# Altium schematic sheet 控制板.SchDoc (part 1 of 2)
size 1397 x 1143 mm; SheetNumber: 0; SheetTotal: 0
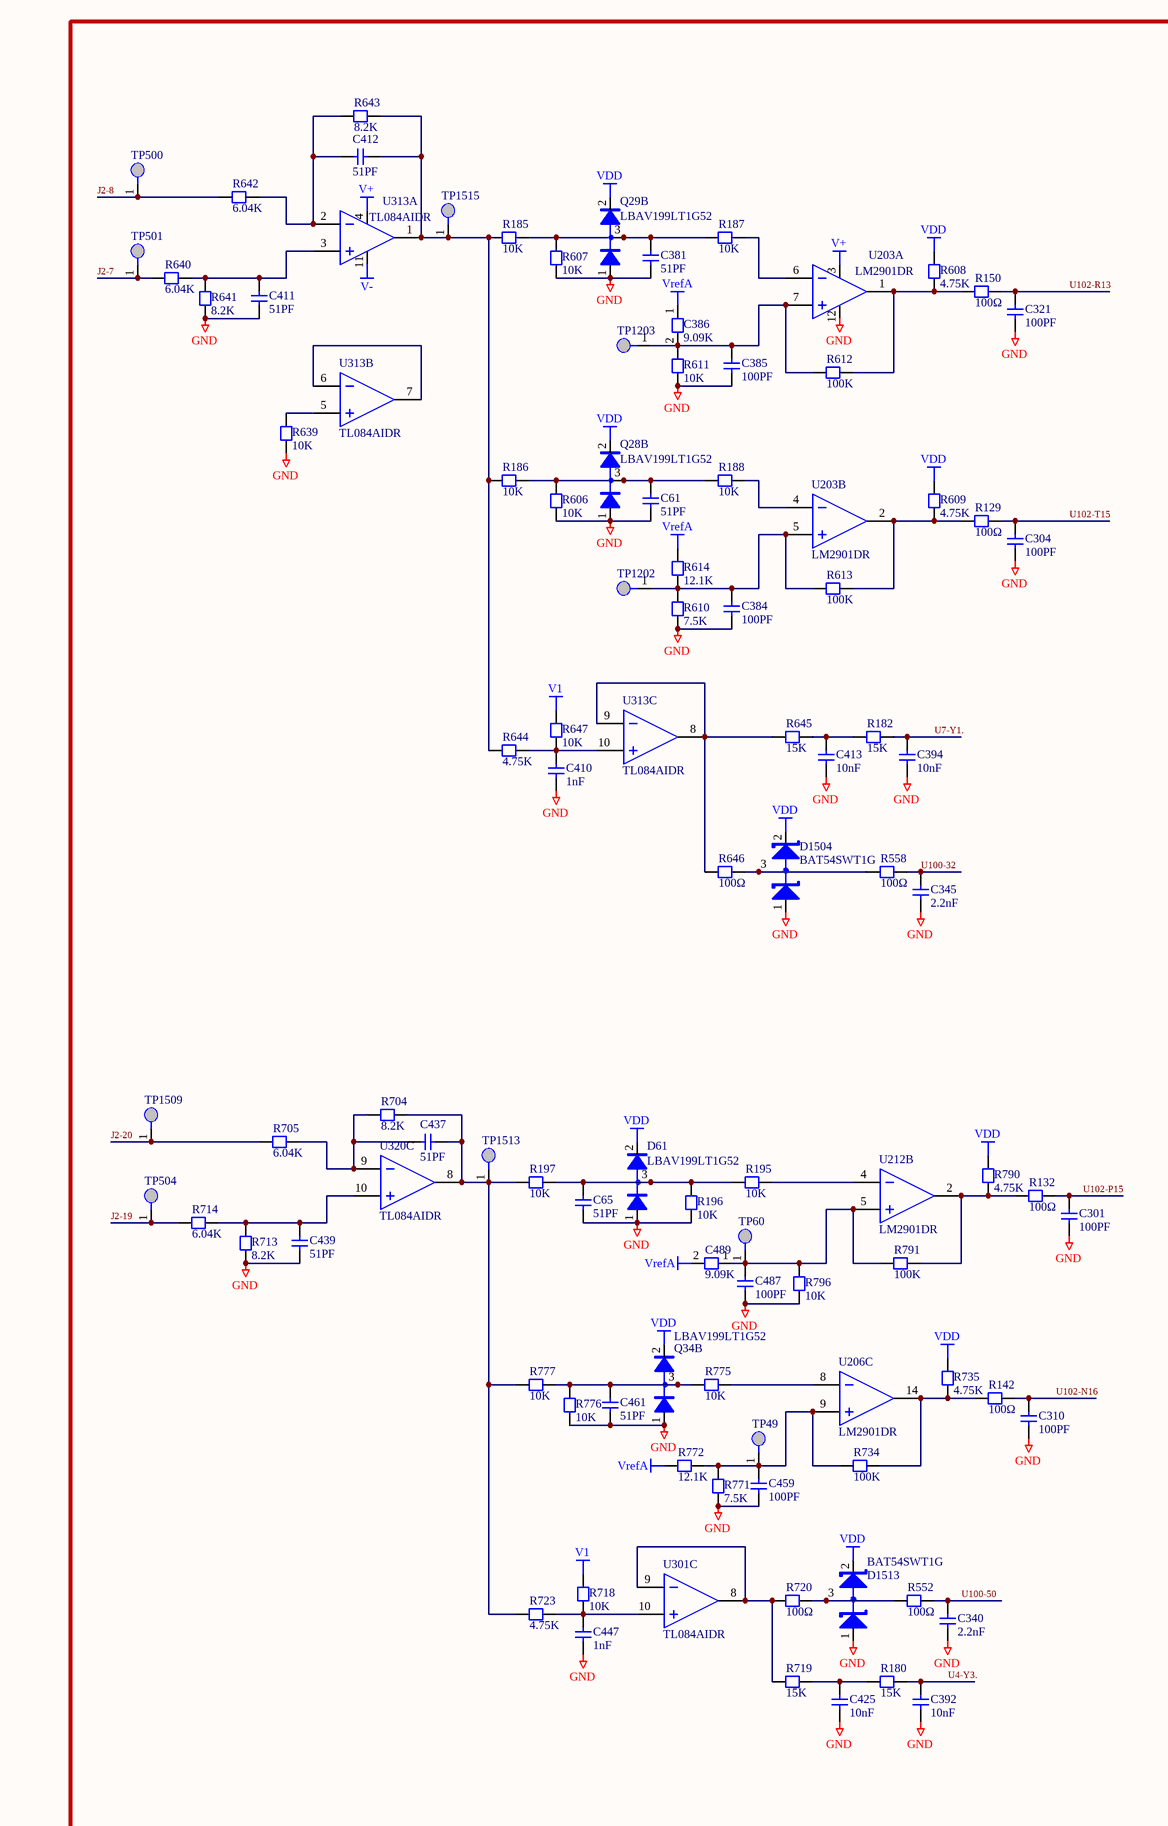
[diagram p0: 控制板.SchDoc, top column 1 of 4]
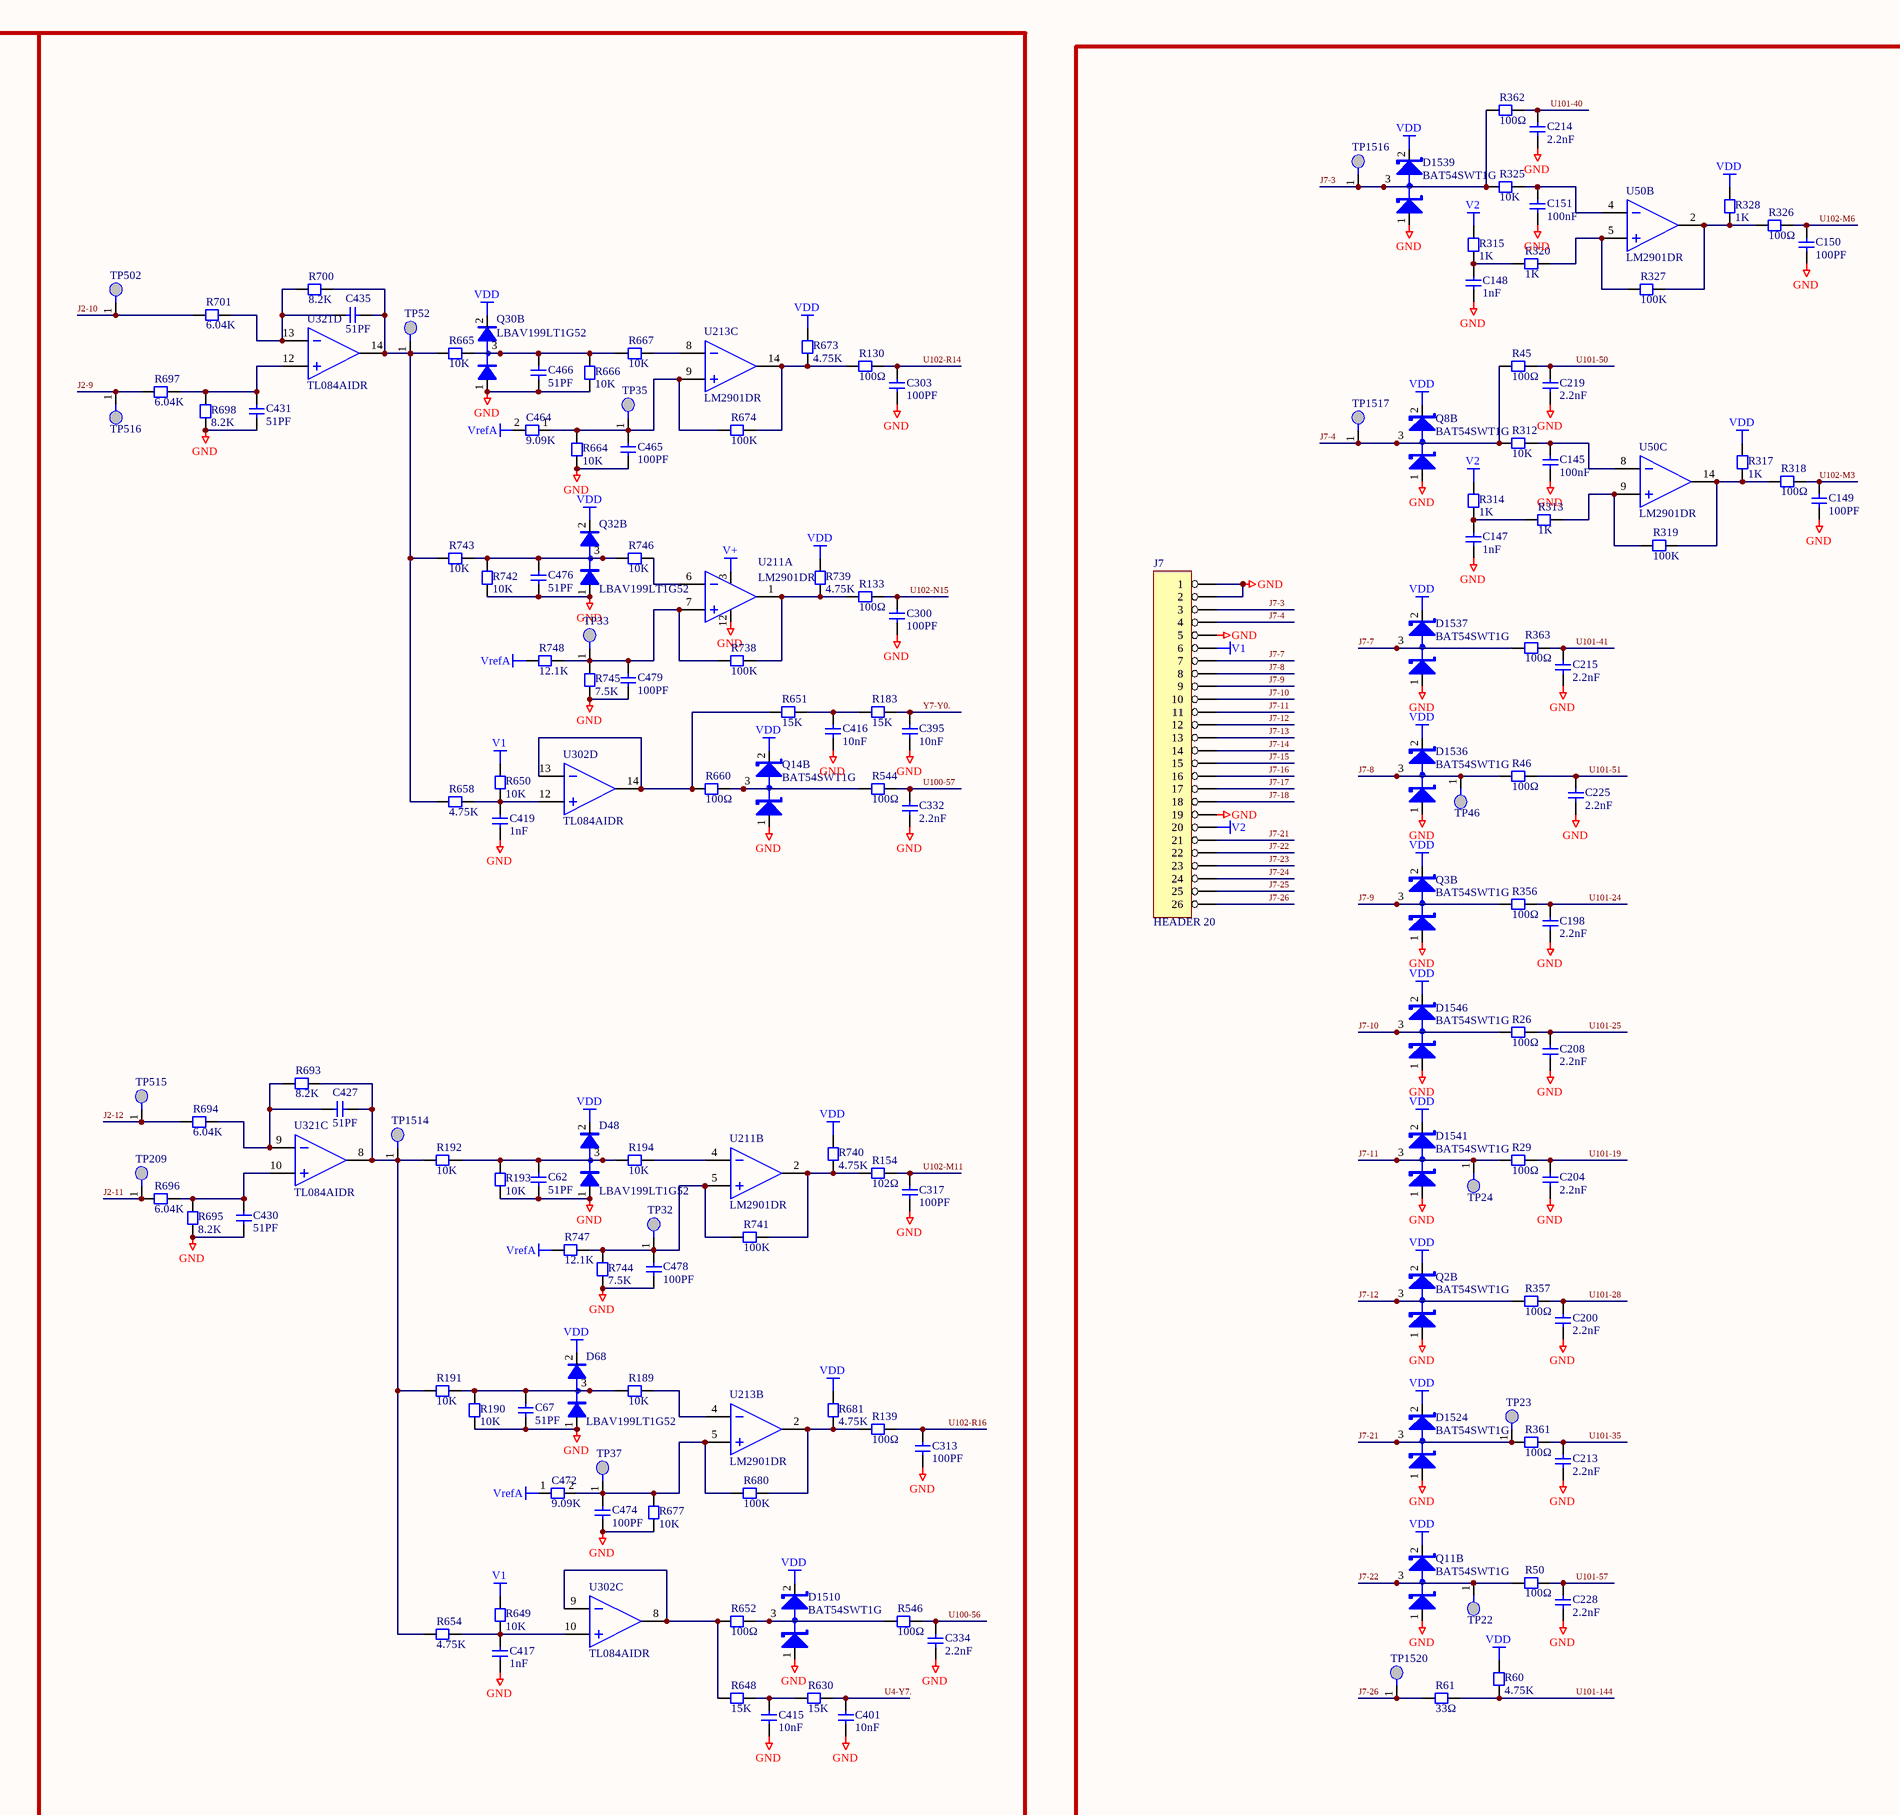
[diagram p1: 控制板.SchDoc, top column 2 of 4]
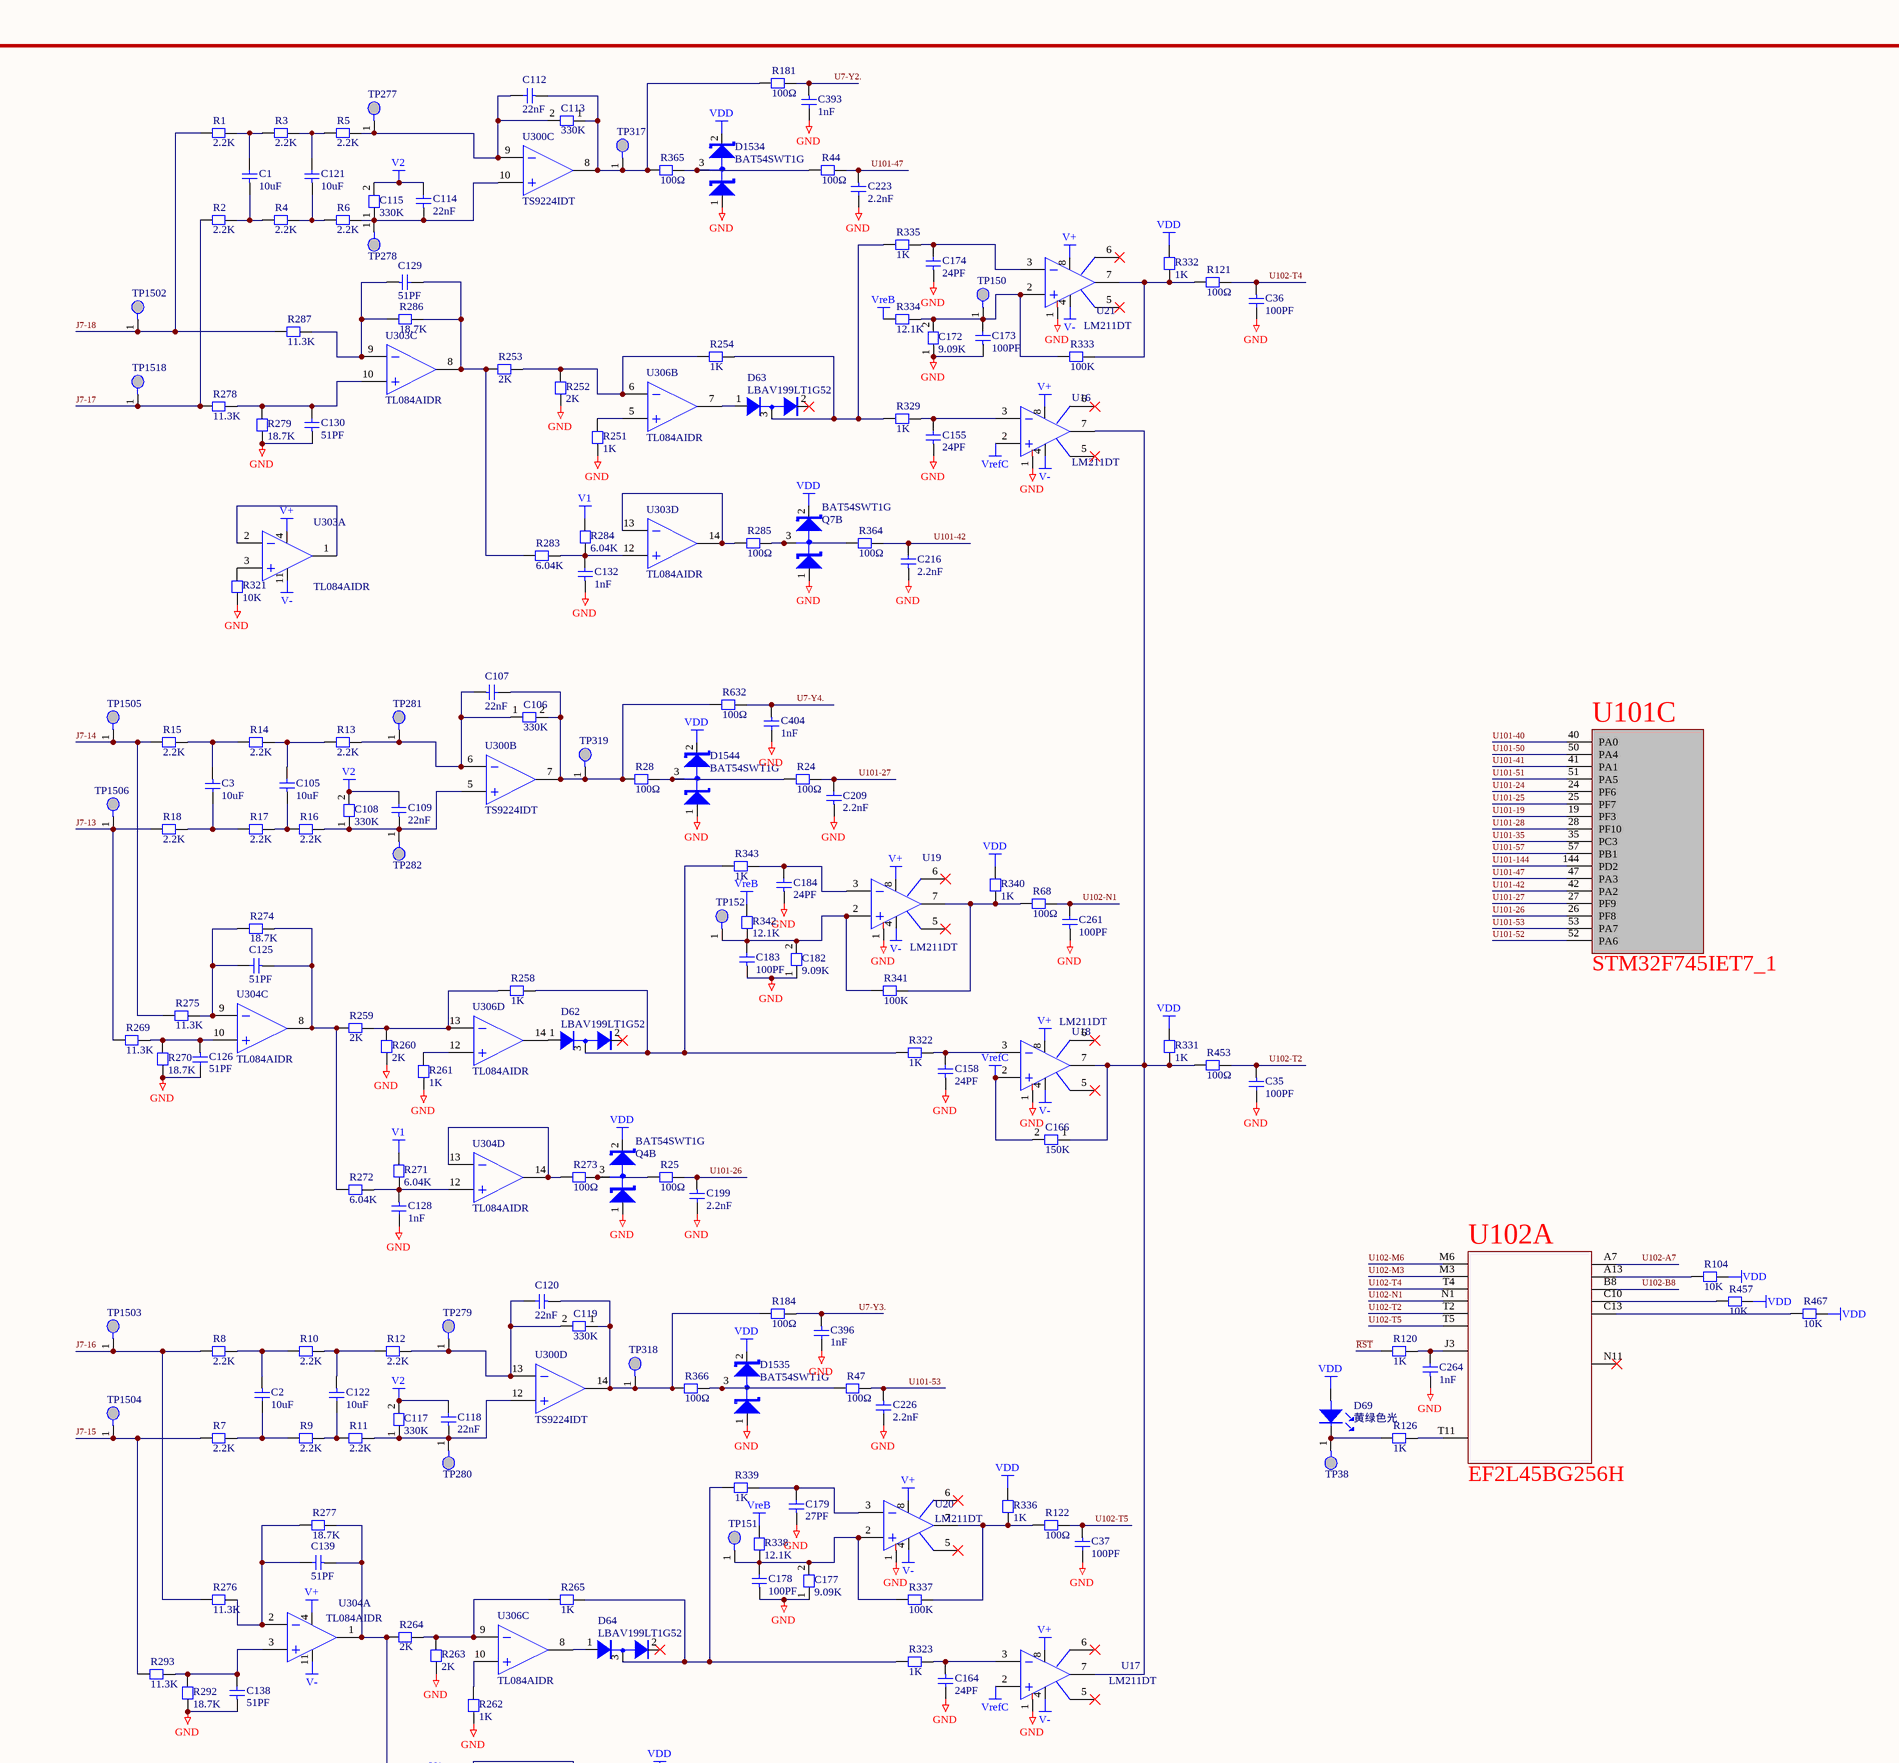
[diagram p2: 控制板.SchDoc, top column 3 of 4]
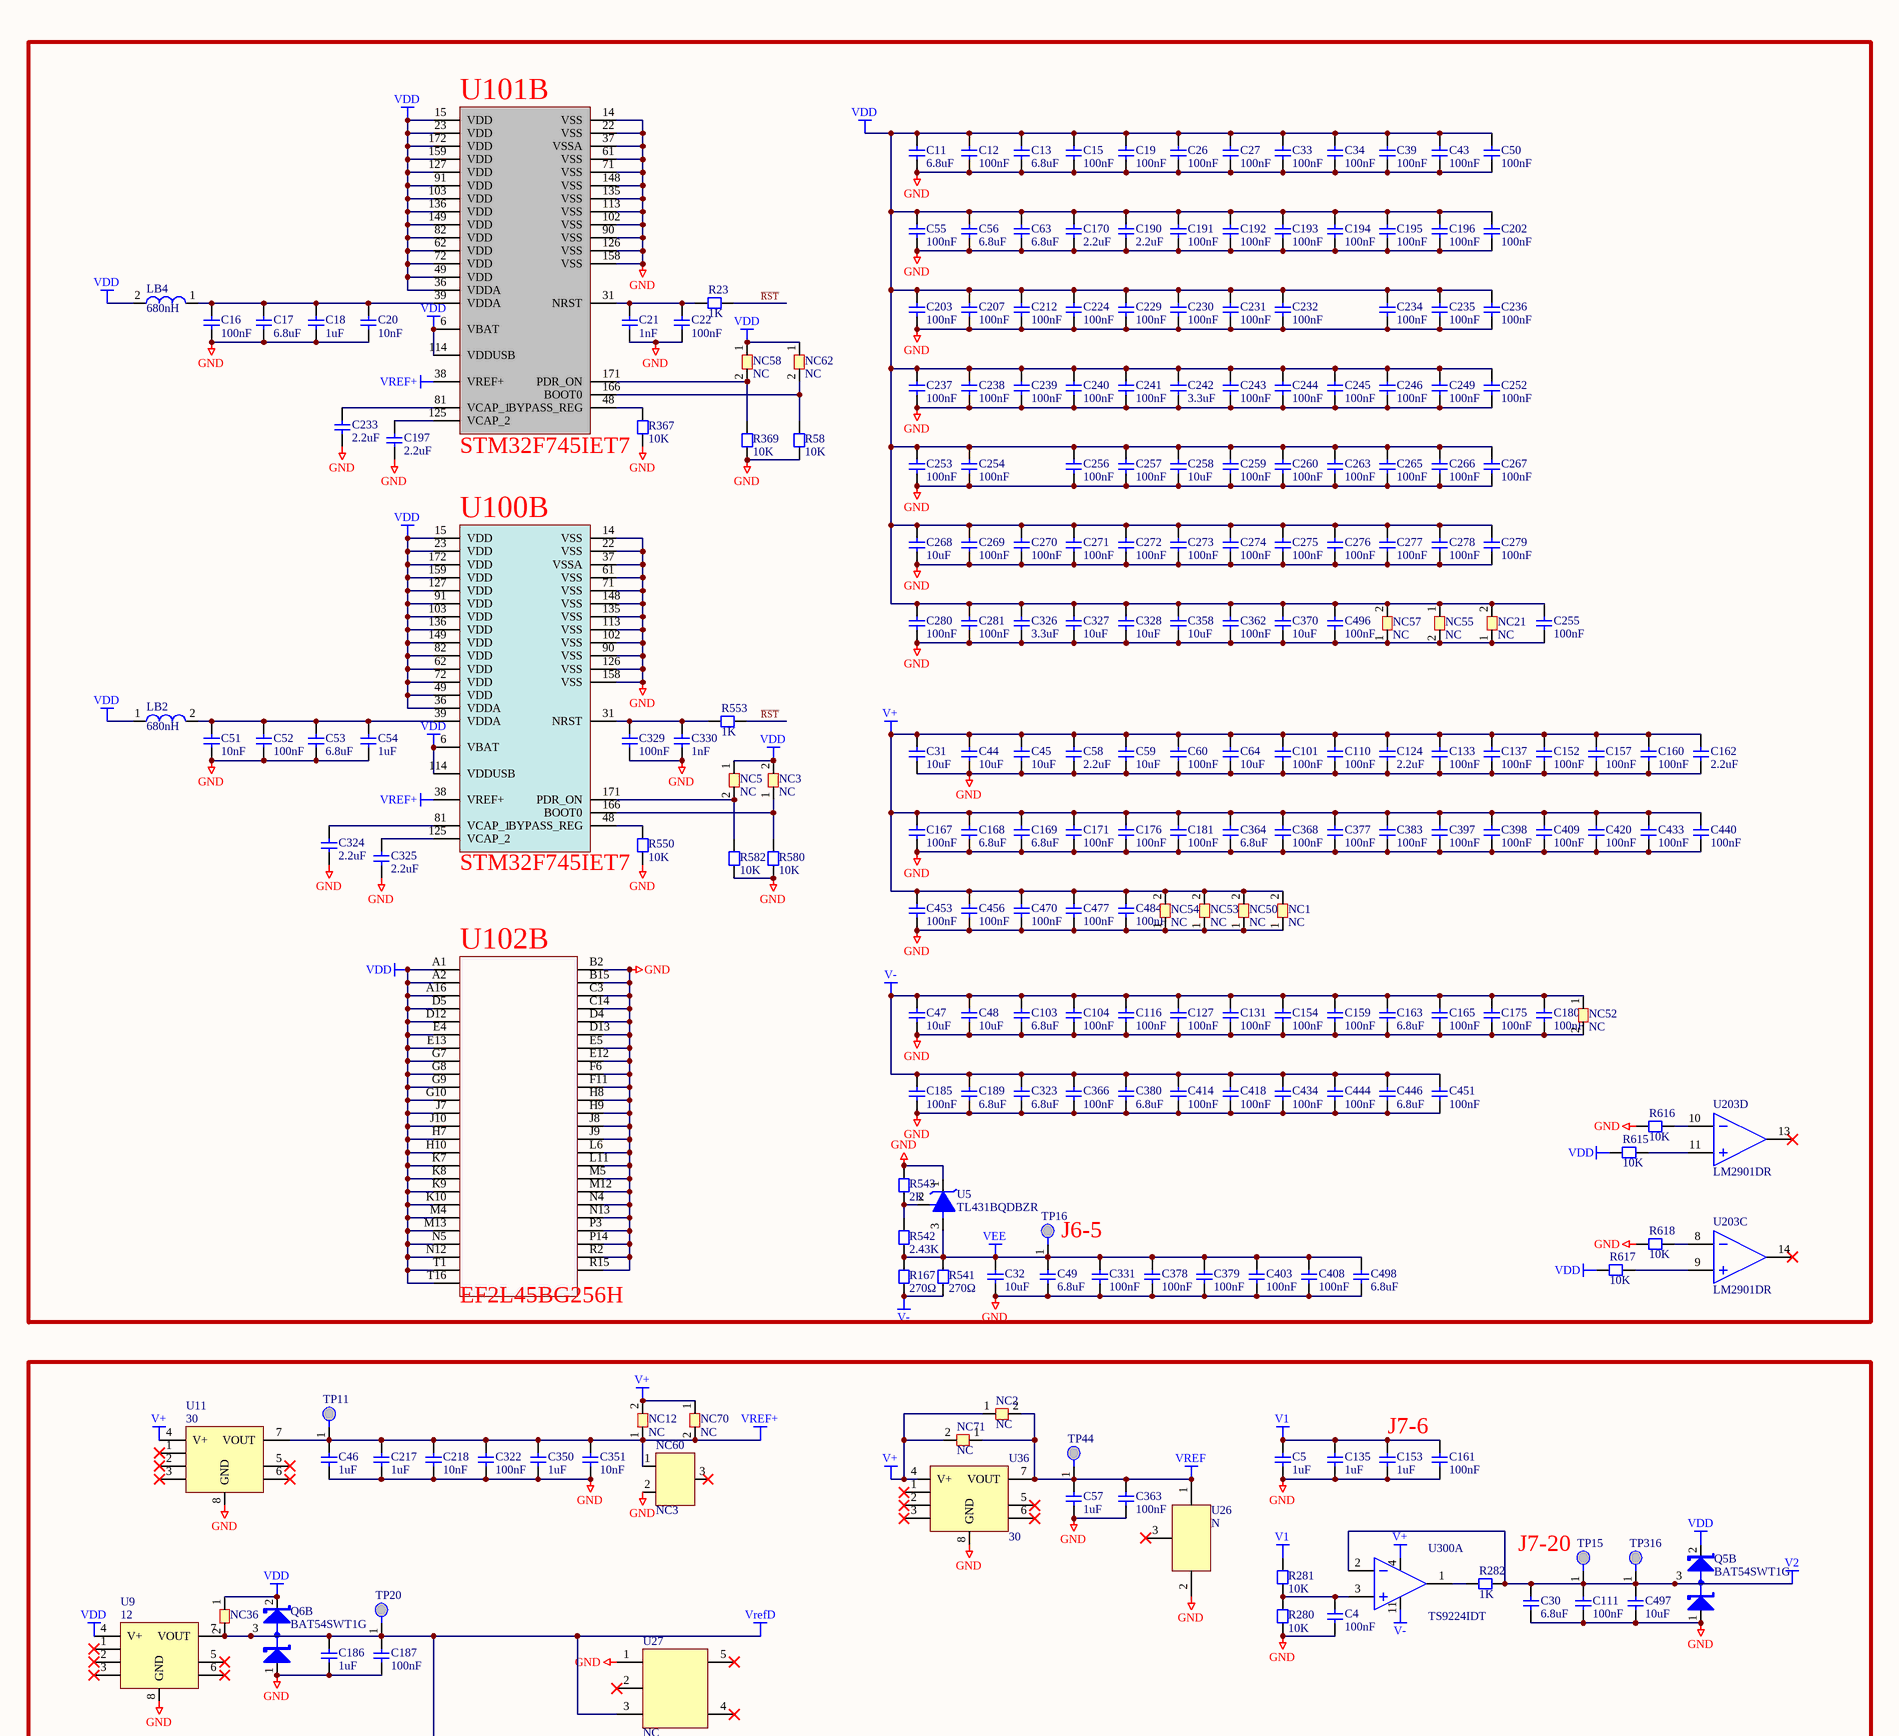
[diagram p3: 控制板.SchDoc, top column 4 of 4]
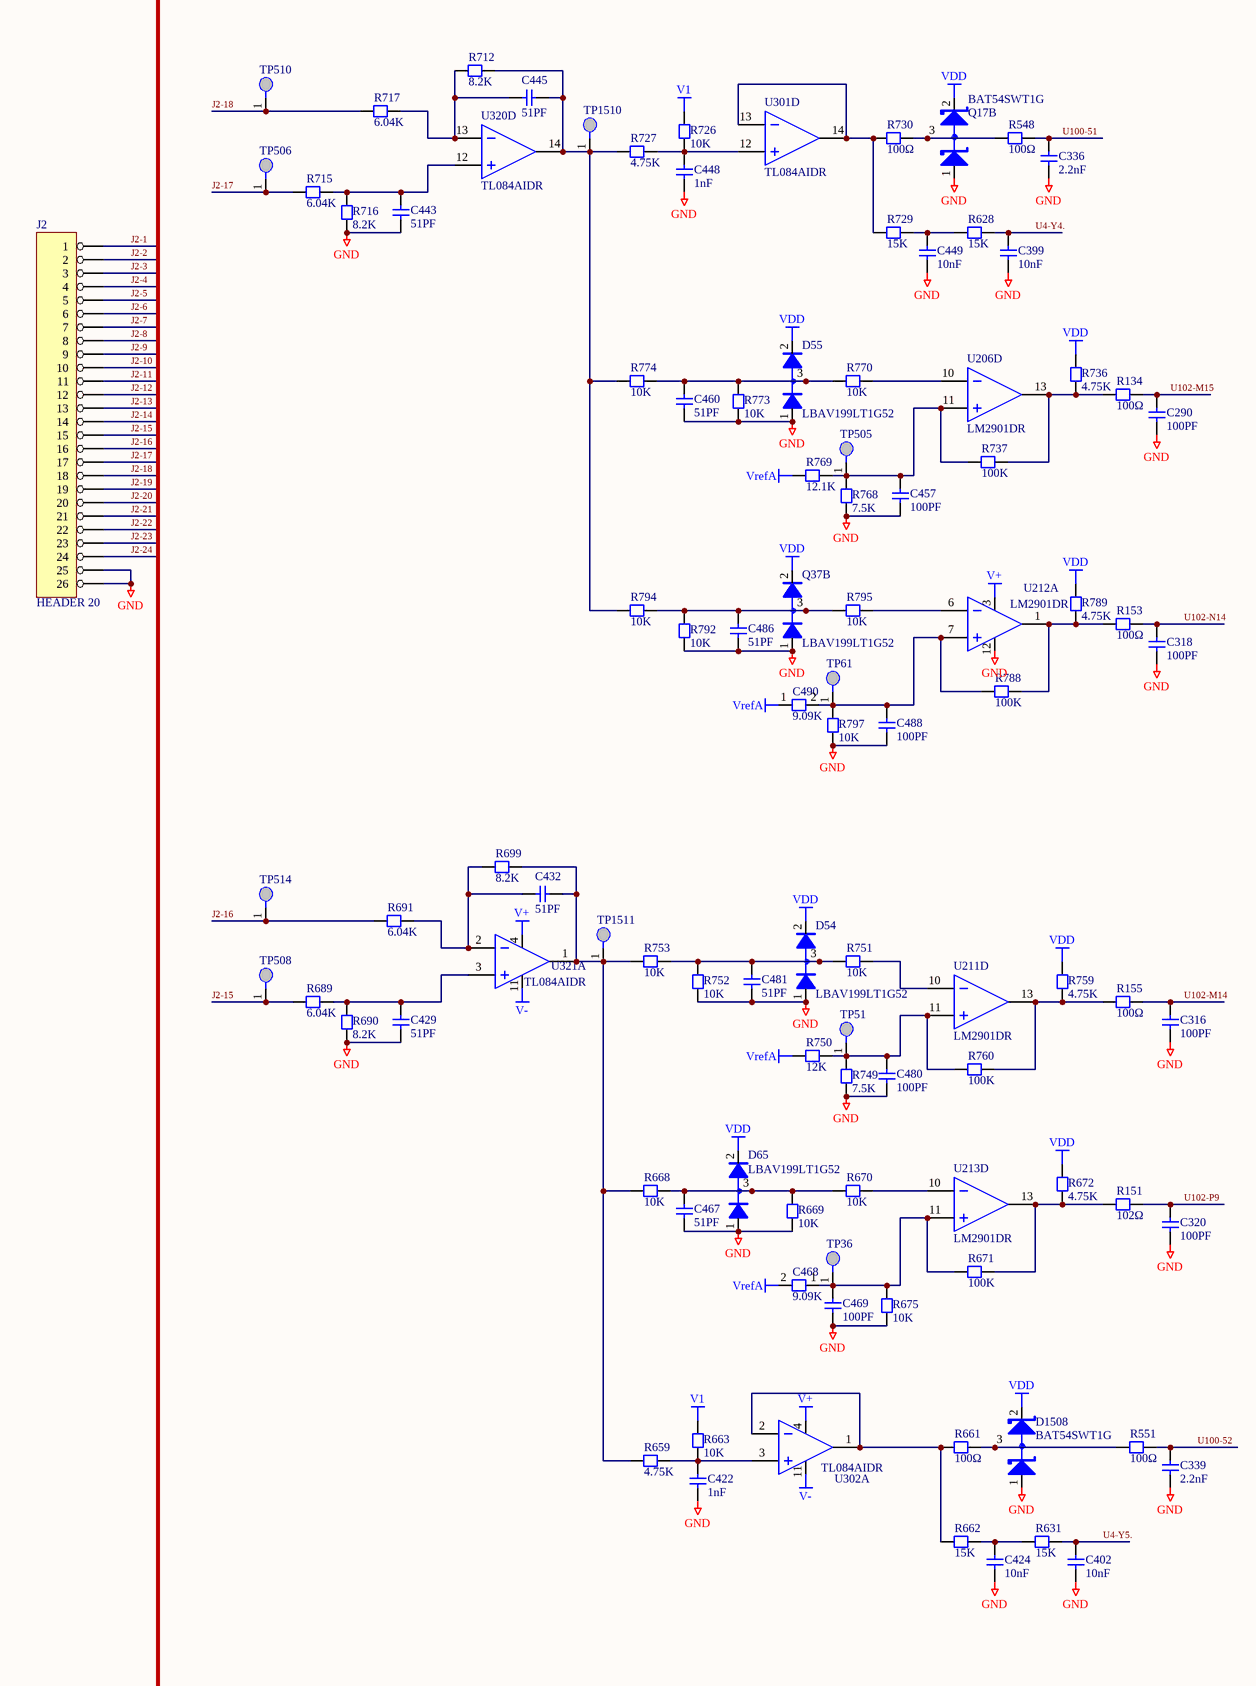
[diagram p4: 控制板.SchDoc, centre column 1 of 4]